# EasyEDA Pro project Q's HelloWorld KeyBoard.eprj, board PCB 主体扩展接口板
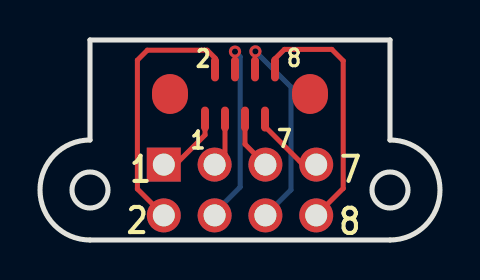
[diagram p11: board, top side]
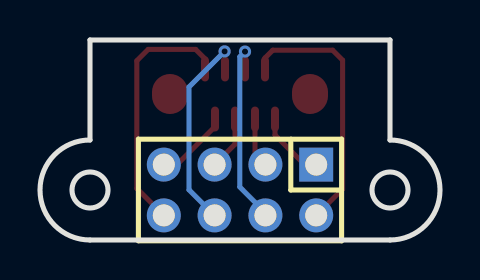
[diagram p12: board, bottom side, seen from below]

Outline 20 x 10 mm; copper layers: Top Layer, Bottom Layer. Coordinates in mm from the lower left corner of the outline.
Outline path: circle c2.5,2.5 r0.9 ; circle c17.5,2.5 r0.9 ; 2.5,10 17.5,10 17.5,5 arc(20,2.5) 17.5,0 2.5,0 arc(0,2.5) 2.5,5 2.5,10
Stack: Top Layer 0.035mm / Dielectric1 1.51mm FR4 er 4.5 / Bottom Layer 0.035mm

## Design rules (mm)
spacing safeClearance (default): track to track 0.152, other pairs 0.152 to 0.3
track width trackWidth (default): min 0.127, default 0.254, max 2.54
differential pair differentialPair (default): width min 0.127, default 0.254, max 2.54; gap min 0.152, default 0.152
via viaSize (default): diameter min 0.5, default 0.61, max 10; hole min 0.3, default 0.305, max 6

## Placement (name value [footprint] x y rotation side)
J1  FPC8-0.5mm  [FPC0.5-8P-STAND]  10 7.3 0 top
U1  MTP125-1204S1  [HDR-TH_8P-P2.54-V-M-R2-C4-S2.54]  10 2.5 0 bottom

## Footprints (pads in the part's own frame, mm; a bottom-side part is the same pattern mirrored in y, then rotated)
FPC0.5-8P-STAND
  rrect 0.4x1.25 smd: 1(-1.75,-1.252) 2(-1.25,1.252) 3(-0.75,-1.252) 4(-0.25,1.252) 5(0.25,-1.252) 6(0.75,1.252) 7(1.25,-1.252) 8(1.75,1.252)
  rrect 1.8x2 smd: 9(-3.5,0) 10(3.5,0)
HDR-TH_8P-P2.54-V-M-R2-C4-S2.54
  rect 1.7x1.7 hole 1.1: 1(-3.81,-1.27)
  round 1.7 hole 1.1: 2(-3.81,1.27) 3(-1.27,-1.27) 4(-1.27,1.27) 5(1.27,-1.27) 6(1.27,1.27) 7(3.81,-1.27) 8(3.81,1.27)

## Nets
As in the schematic.

Pads without a net: J1 9 10

## Via types
v1: diameter 0.61, hole 0.305, Top Layer to Bottom Layer, 2 vias

## Routing (per net, layer and track width the routed paths; a pad name or vN(x,y) marks a point on that pad's centre or on a via; arc(x,y) is an arc through that point)
$1N371: length 3.7
  Top Layer w0.254: U1.1 6.77,3.77 8.25,5.25 8.25,6.25
$1N374: length 13.1
  Top Layer w0.254: U1.2 4.87,2.55 4.87,8.99 5.37,9.49 8.36,9.49 8.75,9.1 J1.2
$1N381: length 2.7
  Top Layer w0.254: 9.25,6.25 9.25,4.29 U1.3
$1N386: length 8.8
  Bottom Layer w0.254: U1.4 8.73,1.37 10.01,2.65 10.01,9.16 v1(9.75,9.42)
$1N393: length 2.9
  Top Layer w0.254: U1.5 10.25,4.79 10.25,6.25
$1N398: length 9.5
  Bottom Layer w0.254: U1.6 12.55,2.51 12.55,7.65 v1(10.77,9.43)
$1N403: length 3.9
  Top Layer w0.254: U1.7 13.15,3.77 11.25,5.67 11.25,6.25
$1N407: length 12.6
  Top Layer w0.254: J1.8 11.75,9.06 12.22,9.53 14.59,9.53 15.16,8.96 15.16,2.58 U1.8

## Text on the board
Document Layer: 板厚：1.0mm
Top Silkscreen Layer: 8 | 1 | 2 | 7
